# EasyEDA Pro project MyWordEdit.eprj, board PCB1
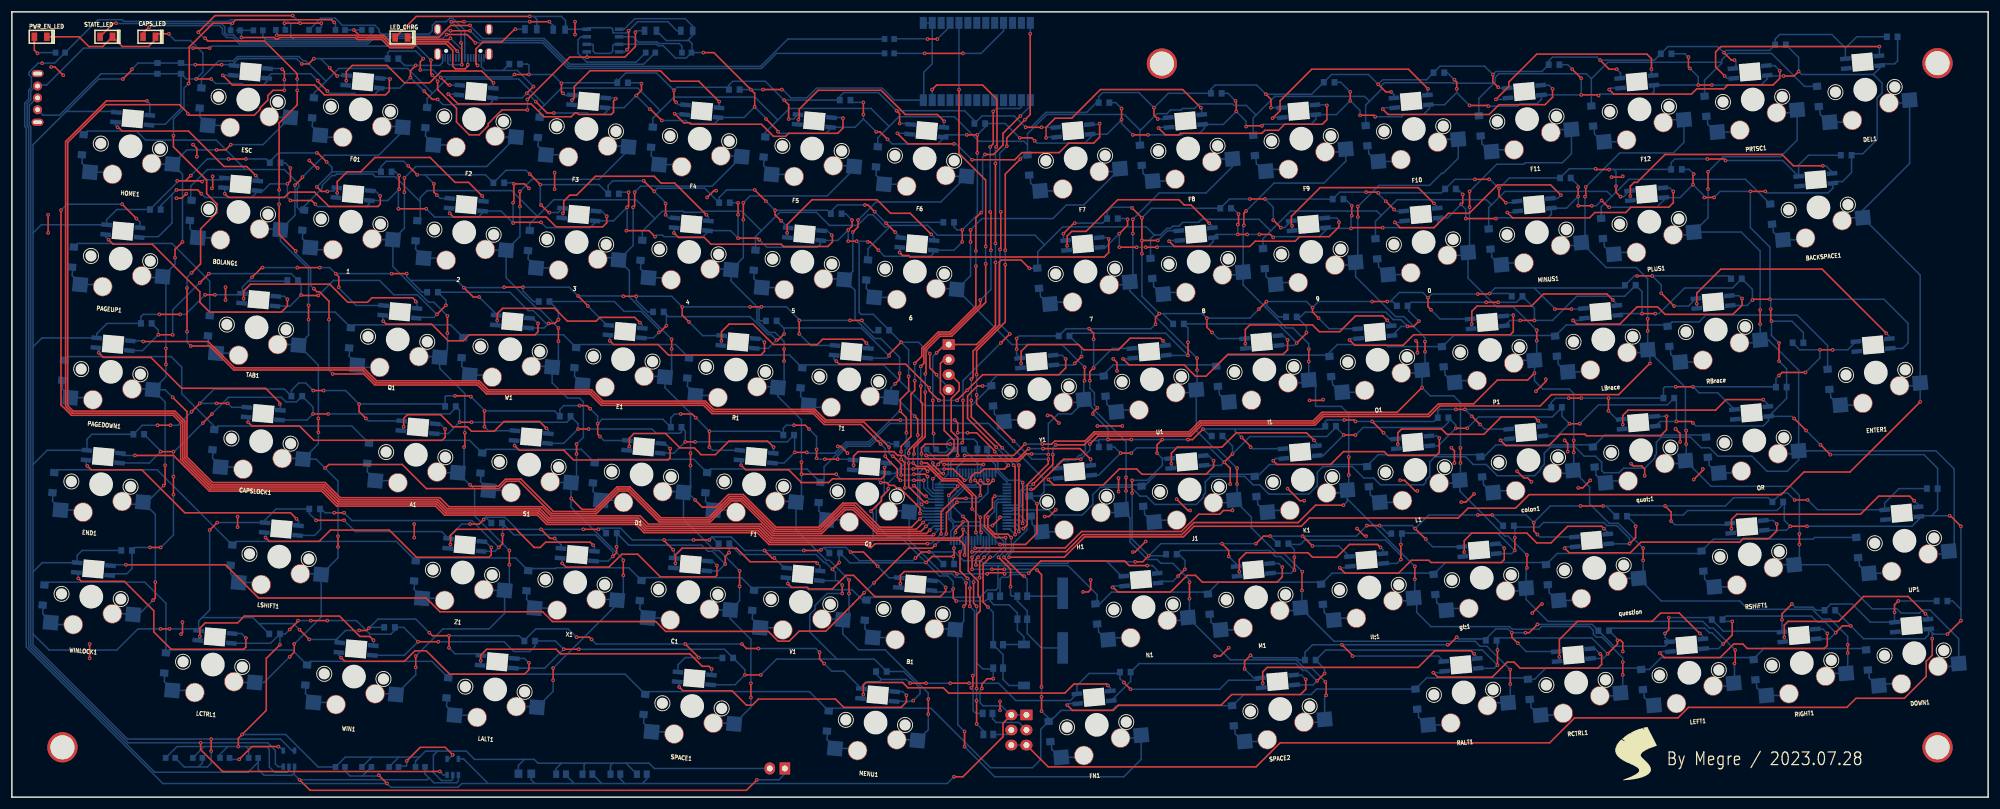
[diagram p2: board, top side]
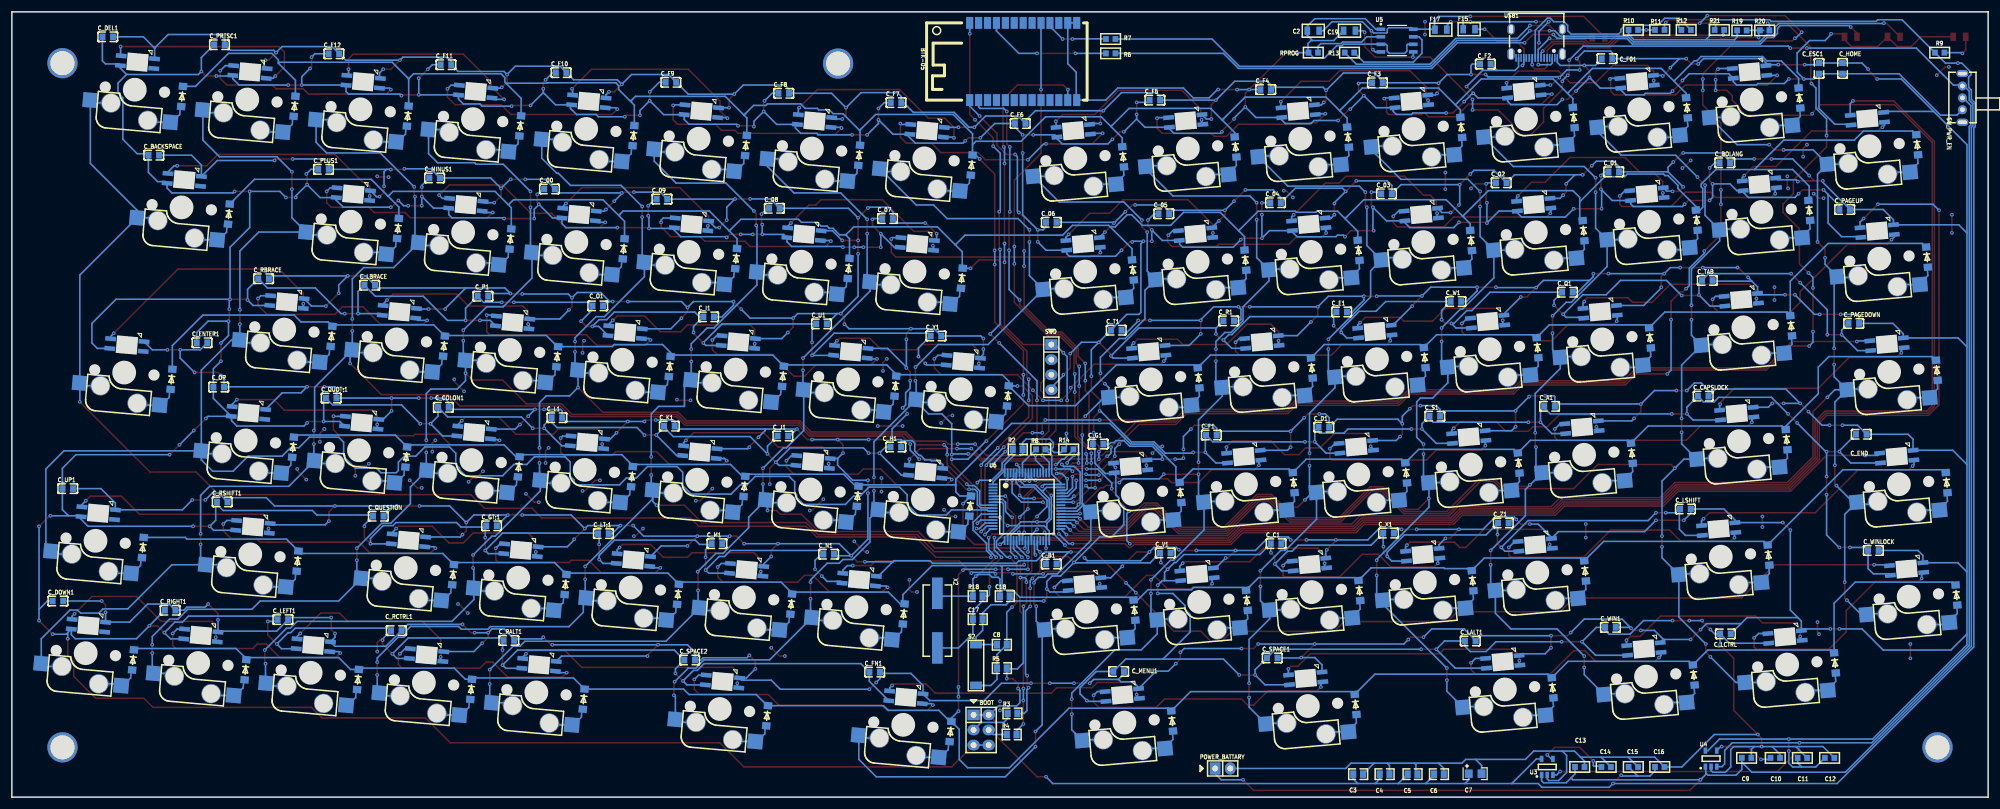
[diagram p3: board, bottom side, seen from below]

Outline 332.49 x 132.21 mm; copper layers: Top Layer, Bottom Layer. Coordinates in mm from the lower left corner of the outline.
Outline path: 0,132.21 332.49,132.21 332.49,0 0,0 0,132.2 0,132.21
Stack: Top Layer 0.035mm / Dielectric1 1.51mm FR4 er 4.5 / Bottom Layer 0.035mm

## Design rules (mm)
template: JLCPCB Capability(Two Layers Board)
spacing copperThickness1oz (default): track to track 0.102, other pairs 0.152 to 0.3
spacing copperThickness2oz: track to track 0.203, other pairs 0.152 to 0.3
track width copperThickness1oz (default): min 0.127, default 0.254, max 2.54
track width copperThickness2oz: min 0.203, default 0.254, max 2.54
differential pair differentialPair (default): width min 0.127, default 0.254, max 2.54; gap min 0.152, default 0.152
via viaSize (default): diameter min 0.5, default 0.61, max 10; hole min 0.3, default 0.305, max 6.3

## Placement (name value [footprint] x y rotation side)
0  -  [KAILH_WS2182B_3528 反贴]  237.49 93.47 5 top
1  -  [KAILH_WS2182B_3528 反贴]  57.02 96.9 355 top
2  -  [KAILH_WS2182B_3528 反贴]  76.07 95.12 355 top
3  -  [KAILH_WS2182B_3528 反贴]  95 93.47 355 top
4  -  [KAILH_WS2182B_3528 反贴]  113.92 91.82 355 top
5  -  [KAILH_WS2182B_3528 反贴]  132.97 90.17 355 top
6  -  [KAILH_WS2182B_3528 反贴]  151.89 88.52 355 top
7  -  [KAILH_WS2182B_3528 反贴]  180.59 88.52 5 top
8  -  [KAILH_WS2182B_3528 反贴]  199.64 90.17 5 top
9  -  [KAILH_WS2182B_3528 反贴]  218.57 91.82 5 top
A1  -  [KAILH_WS2182B_3528 反贴]  67.95 57.66 355 top
B1  -  [KAILH_WS2182B_3528 反贴]  151.64 31.24 355 top
BACKSPACE1  -  [KAILH_WS2182B_3528 反贴]  303.91 99.31 5 top
BOLANG1  -  [KAILH_WS2182B_3528 反贴]  38.1 98.55 355 top
BOOT  HDR2x3  [PIN-2x3-2.54-1.0]  169.42 11.3 270 bottom
BTK-05  BTK-05-blueteeth  [BTK-05-bluteeth]  164.59 124.05 90 bottom
C1  -  [KAILH_WS2182B_3528 反贴]  113.79 34.54 355 top
C2  10uf  [0805]  113.54 129.03 180 bottom
C3  100nF  [RC0603]  106.81 3.86 180 bottom
C4  100nF  [RC0603]  102.36 3.86 180 bottom
C5  100nF  [RC0603]  97.66 3.86 180 bottom
C6  100nF  [RC0603]  93.22 3.86 180 bottom
C7  10uf  [CAP0805]  87.38 3.94 180 bottom
C8  100nF  [RC0603]  165.1 25.65 0 bottom
C9  105  [0603]  40.64 6.6 180 bottom
C10  22nf  [0603]  35.81 6.6 180 bottom
C11  104  [0603]  31.25 6.6 180 bottom
C12  105  [0603]  26.67 6.6 180 bottom
C13  105  [0603]  68.71 5.08 180 bottom
C14  22nf  [0603]  64.26 5.08 180 bottom
C15  104  [0603]  59.69 5.08 180 bottom
C16  105  [0603]  55.25 5.08 180 bottom
C17  20pF  [RC0603]  170.82 29.96 180 bottom
C18  20pF  [RC0603]  166.25 33.83 180 bottom
C19  10uf  [0805]  107.44 129.03 180 bottom
C_00  100nF  [C0603]  242.04 102.39 180 bottom
C_01  100nF  [C0603]  62.99 105.28 180 bottom
C_02  100nF  [C0603]  81.92 103.43 180 bottom
C_03  100nF  [C0603]  101.22 101.57 180 bottom
C_04  100nF  [C0603]  119.89 100.08 180 bottom
C_05  100nF  [C0603]  138.68 98.22 180 bottom
C_06  100nF  [C0603]  157.61 96.77 180 bottom
C_07  100nF  [C0603]  185.17 97.41 180 bottom
C_08  100nF  [C0603]  204.2 99.14 180 bottom
C_09  100nF  [C0603]  223.12 100.68 180 bottom
C_A1  100nF  [C0603]  73.79 65.79 180 bottom
C_B1  100nF  [C0603]  157.61 39.24 180 bottom
C_BACKSPACE  100nF  [C0603]  308.61 108.08 180 bottom
C_BOLANG  100nF  [C0603]  44.3 106.81 180 bottom
C_C1  100nF  [C0603]  119.8 42.67 180 bottom
C_CAPSLOCK  100nF  [C0603]  47.93 67.51 180 bottom
C_COLON1  100nF  [C0603]  259.88 65.63 180 bottom
C_D1  100nF  [C0603]  111.76 62.28 180 bottom
C_DEL1  100nF  [C0603]  316.36 128.02 180 bottom
C_DOWN1  100nF  [C0603]  324.74 33.02 180 bottom
C_E1  100nF  [C0603]  108.76 81.69 180 bottom
C_END  100nF  [C0603]  21.34 61.09 180 bottom
C_ENTER1  100nF  [C0603]  300.5 76.5 180 bottom
C_ESC1  100nF  [C0603]  28.45 122.69 90 bottom
C_F1  100nF  [C0603]  130.68 60.96 180 bottom
C_F01  100nF  [C0603]  64.12 124.33 180 bottom
C_F2  100nF  [C0603]  84.58 123.41 0 bottom
C_F3  100nF  [C0603]  102.74 120.27 180 bottom
C_F4  100nF  [C0603]  121.54 119.13 180 bottom
C_F5  100nF  [C0603]  140.18 117.35 180 bottom
C_F6  100nF  [C0603]  162.84 113.41 180 bottom
C_F7  100nF  [C0603]  183.74 116.92 180 bottom
C_F8  100nF  [C0603]  202.63 118.5 180 bottom
C_F9  100nF  [C0603]  221.62 120.35 180 bottom
C_F10  100nF  [C0603]  240.09 121.98 180 bottom
C_F11  100nF  [C0603]  259.46 123.32 180 bottom
C_F12  100nF  [C0603]  278.31 125.15 180 bottom
C_FN1  100nF  [C0603]  187.33 21.05 180 bottom
C_G1  100nF  [C0603]  149.73 59.44 180 bottom
C_GT;1  100nF  [C0603]  251.79 45.68 180 bottom
C_H1  100nF  [C0603]  183.77 58.95 180 bottom
C_HOME  100nF  [C0603]  24.49 122.69 90 bottom
C_I1  100nF  [C0603]  215.27 80.86 180 bottom
C_J1  100nF  [C0603]  202.77 60.8 180 bottom
C_K1  100nF  [C0603]  221.87 62.45 180 bottom
C_L1  100nF  [C0603]  240.79 63.88 180 bottom
C_LALT1  100nF  [C0603]  87.12 26.29 180 bottom
C_LBRACE  100nF  [C0603]  272.29 86.18 180 bottom
C_LCTRL  100nF  [C0603]  44.2 27.48 180 bottom
C_LEFT1  100nF  [C0603]  286.89 29.89 180 bottom
C_LSHIFT  100nF  [C0603]  50.93 48.51 180 bottom
C_LT;1  100nF  [C0603]  232.97 44.37 180 bottom
C_M1  100nF  [C0603]  213.87 42.67 180 bottom
C_MENU1  100nF  [C0603]  146.28 21.15 180 bottom
C_MINUS1  100nF  [C0603]  261.37 104.24 180 bottom
C_N1  100nF  [C0603]  195.07 40.89 180 bottom
C_O1  100nF  [C0603]  233.92 82.71 180 bottom
C_OR  100nF  [C0603]  297.69 69.04 180 bottom
C_P1  100nF  [C0603]  253.24 84.33 180 bottom
C_PAGEDOWN  100nF  [C0603]  22.61 79.76 180 bottom
C_PAGEUP  100nF  [C0603]  24.13 98.93 180 bottom
C_PLUS1  100nF  [C0603]  280.06 105.69 180 bottom
C_PRTSC1  100nF  [C0603]  297.56 126.68 180 bottom
C_Q1  100nF  [C0603]  70.77 85 180 bottom
C_QUESTION  100nF  [C0603]  270.84 47.29 180 bottom
C_QUOT;1  100nF  [C0603]  278.77 67.18 180 bottom
C_R1  100nF  [C0603]  127.76 80.19 180 bottom
C_RALT1  100nF  [C0603]  248.88 26.38 180 bottom
C_RBRACE  100nF  [C0603]  290.14 87.28 180 bottom
C_RCTRL1  100nF  [C0603]  267.81 28.03 180 bottom
C_RIGHT1  100nF  [C0603]  305.86 31.46 180 bottom
C_RSHIFT1  100nF  [C0603]  297.1 49.71 180 bottom
C_S1  100nF  [C0603]  93.09 64.13 180 bottom
C_SPACE1  100nF  [C0603]  120.44 23.43 180 bottom
C_SPACE2  100nF  [C0603]  218.45 23.08 180 bottom
C_T1  100nF  [C0603]  146.69 78.61 180 bottom
C_TAB  100nF  [C0603]  47.24 86.99 180 bottom
C_U1  100nF  [C0603]  196.27 79.68 180 bottom
C_UP1  100nF  [C0603]  323.09 51.94 180 bottom
C_V1  100nF  [C0603]  138.43 41.1 180 bottom
C_W1  100nF  [C0603]  89.54 83.44 180 bottom
C_WIN1  100nF  [C0603]  63.54 28.58 180 bottom
C_WINLOCK  100nF  [C0603]  19.3 41.53 180 bottom
C_X1  100nF  [C0603]  100.88 44.45 180 bottom
C_Y1  100nF  [C0603]  177.02 77.64 180 bottom
C_Z1  100nF  [C0603]  81.57 46.16 180 bottom
CAPS_LED  LED  [LED-0805]  23.11 128.02 0 top
CAPSLOCK1  -  [KAILH_WS2182B_3528 反贴]  41.91 59.94 355 top
colon1  -  [KAILH_WS2182B_3528 反贴]  255.14 56.77 5 top
D1  -  [KAILH_WS2182B_3528 反贴]  105.92 54.36 355 top
DEL1  -  [KAILH_WS2182B_3528 反贴]  311.79 119.13 5 top
DOWN1  -  [KAILH_WS2182B_3528 反贴]  320.04 24.26 5 top
E1  -  [KAILH_WS2182B_3528 反贴]  102.8 73.76 355 top
END1  -  [KAILH_WS2182B_3528 反贴]  14.99 52.7 355 top
ENTER1  -  [KAILH_WS2182B_3528 反贴]  313.56 71.5 5 top
ESC  -  [KAILH_WS2182B_3528 反贴]  39.75 117.47 355 top
F1  -  [KAILH_WS2182B_3528 反贴]  124.84 52.7 355 top
F01  -  [KAILH_WS2182B_3528 反贴]  58.67 115.82 355 top
F2  -  [KAILH_WS2182B_3528 反贴]  77.72 114.17 355 top
F3  -  [KAILH_WS2182B_3528 反贴]  96.65 112.52 355 top
F4  -  [KAILH_WS2182B_3528 反贴]  115.7 110.87 355 top
F5  -  [KAILH_WS2182B_3528 反贴]  134.62 109.22 355 top
F6  -  [KAILH_WS2182B_3528 反贴]  153.54 107.57 355 top
F7  -  [KAILH_WS2182B_3528 反贴]  178.94 107.57 5 top
F8  -  [KAILH_WS2182B_3528 反贴]  197.87 109.22 5 top
F9  -  [KAILH_WS2182B_3528 反贴]  216.92 110.87 5 top
F10  -  [KAILH_WS2182B_3528 反贴]  235.84 112.52 5 top
F11  -  [KAILH_WS2182B_3528 反贴]  254.89 114.17 5 top
F12  -  [KAILH_WS2182B_3528 反贴]  273.81 115.82 5 top
F15  500mA  [0805]  87.32 129.29 180 bottom
F17  500mA  [0805]  92.08 129.21 180 bottom
FN1  -  [KAILH_WS2182B_3528 反贴]  182.5 12.19 5 top
G1  -  [KAILH_WS2182B_3528 反贴]  143.89 51.05 355 top
gt;1  -  [KAILH_WS2182B_3528 反贴]  247.27 36.96 5 top
H1  -  [KAILH_WS2182B_3528 反贴]  179.2 50.16 5 top
HOME1  -  [KAILH_WS2182B_3528 反贴]  19.94 109.6 355 top
I1  -  [KAILH_WS2182B_3528 反贴]  210.69 72.01 5 top
J1  -  [KAILH_WS2182B_3528 反贴]  198.12 51.82 5 top
K1  -  [KAILH_WS2182B_3528 反贴]  217.17 53.47 5 top
L1  -  [KAILH_WS2182B_3528 反贴]  236.09 55.12 5 top
LALT1  -  [KAILH_WS2182B_3528 反贴]  81.28 18.16 355 top
LBrace  -  [KAILH_WS2182B_3528 反贴]  267.72 77.09 5 top
LCTRL1  -  [KAILH_WS2182B_3528 反贴]  33.78 22.35 355 top
LED_CHRG  LED  [LED-0805]  65.53 127.89 0 top
LEFT1  -  [KAILH_WS2182B_3528 反贴]  282.19 20.95 5 top
LSHIFT1  -  [KAILH_WS2182B_3528 反贴]  44.96 40.51 355 top
lt;1  -  [KAILH_WS2182B_3528 反贴]  228.35 35.31 5 top
M1  -  [KAILH_WS2182B_3528 反贴]  209.3 33.66 5 top
MENU1  -  [KAILH_WS2182B_3528 反贴]  145.29 12.57 355 top
MINUS1  -  [KAILH_WS2182B_3528 反贴]  256.54 95.12 5 top
N1  -  [KAILH_WS2182B_3528 反贴]  190.37 32 5 top
NOREF  -  [Pad_e82422]  323.98 123.57 0 top
NOREF#2  -  [Pad_e82437]  193.48 123.51 0 top
NOREF#3  -  [Pad_e82416]  323.98 8.38 0 top
NOREF#4  -  [Pad_e82421]  8.51 8.38 0 top
O1  -  [KAILH_WS2182B_3528 反贴]  229.74 73.66 5 top
OR  -  [KAILH_WS2182B_3528 反贴]  293.12 60.07 5 top
P1  -  [KAILH_WS2182B_3528 反贴]  248.67 75.31 5 top
PAGEDOWN1  -  [KAILH_WS2182B_3528 反贴]  16.64 71.63 355 top
PAGEUP1  -  [KAILH_WS2182B_3528 反贴]  18.29 90.68 355 top
PLUS1  -  [KAILH_WS2182B_3528 反贴]  275.46 96.9 5 top
POWER_BATTARY  HDR1x2  [PIN-2-2.54-1.0]  128.78 4.83 180 bottom
PRTSC1  -  [KAILH_WS2182B_3528 反贴]  292.86 117.47 5 top
PWR_EN_LED  LED  [LED-0805]  4.83 128.02 0 top
Q1  -  [KAILH_WS2182B_3528 反贴]  64.9 77.09 355 top
question  -  [KAILH_WS2182B_3528 反贴]  266.19 38.61 5 top
quot;1  -  [KAILH_WS2182B_3528 反贴]  274.07 58.42 5 top
R1  -  [KAILH_WS2182B_3528 反贴]  121.79 72.01 355 top
R2  0R  [RC0603]  164.08 58.55 180 bottom
R3  10K  [RC0603]  164.97 14.1 180 bottom
R4  10K  [RC0603]  163.45 10.54 0 bottom
R5  10K  [RC0603]  166.75 21.72 180 bottom
R6  1k  [0603]  147.63 125.22 180 bottom
R7  1k  [0603]  147.63 127.63 180 bottom
R8  10K  [0603]  159.39 58.55 0 bottom
R9  1k  [0603]  8.15 125.35 0 bottom
R10  1.5K  [0603]  59.69 129.17 180 bottom
R11  22R  [0603]  55.25 129.17 0 bottom
R12  22R  [0603]  50.8 129.17 180 bottom
R13  1k  [0603]  107.44 125.35 0 bottom
R14  10K  [0603]  154.69 58.55 180 bottom
R18  1M  [RC0603]  170.82 33.84 180 bottom
R19  1.5K  [0603]  41.43 129.09 180 bottom
R20  22R  [0603]  37.59 129.09 0 bottom
R21  22R  [0603]  45.21 129.17 180 bottom
RALT1  -  [KAILH_WS2182B_3528 反贴]  244.22 17.65 5 top
RBrace  -  [KAILH_WS2182B_3528 反贴]  286.64 78.74 5 top
RCTRL1  -  [KAILH_WS2182B_3528 反贴]  263.14 19.3 5 top
RIGHT1  -  [KAILH_WS2182B_3528 反贴]  301.12 22.61 5 top
RPROG  2k  [0603]  113.54 125.35 180 bottom
RSHIFT1  -  [KAILH_WS2182B_3528 反贴]  292.35 40.89 5 top
S1  -  [KAILH_WS2182B_3528 反贴]  87 56.01 355 top
S2  RESET  [SMT-KEY]  170.28 18.8 180 bottom
SPACE1  -  [KAILH_WS2182B_3528 反贴]  114.43 15.37 355 top
SPACE2  -  [KAILH_WS2182B_3528 反贴]  213.36 14.86 5 top
STATE_LED  LED  [LED-0805]  15.88 128.02 0 top
SW_PWR_EN  SWITCH-SPST  [SW-TH_SK-12D02-G040]  4.32 117.73 90 bottom
SWD  HDR1x4  [PIN-4-2.54-1.0]  157.61 72.39 270 bottom
T1  -  [KAILH_WS2182B_3528 反贴]  140.84 70.36 355 top
TAB1  -  [KAILH_WS2182B_3528 反贴]  41.15 79.12 355 top
U1  -  [KAILH_WS2182B_3528 反贴]  191.77 70.36 5 top
U3  RT9193-33GB  [SOT-23-5]  74.17 5.08 180 bottom
U4  RT9193-46GB  [SOT-23-5]  46.61 6.48 180 bottom
U5  TP4056  [ESOP8]  99.44 127.38 180 bottom
U6  STM32F103RCT6  [QFP-64-0.5]  161.71 48.89 180 bottom
UP1  -  [KAILH_WS2182B_3528 反贴]  318.39 43.18 5 top
USB1  -  [USB_TYPE-C-16P]  75.82 126.87 0 bottom
V1  -  [KAILH_WS2182B_3528 反贴]  132.72 32.89 355 top
W1  -  [KAILH_WS2182B_3528 反贴]  83.82 75.44 355 top
WIN1  -  [KAILH_WS2182B_3528 反贴]  57.53 20.32 355 top
WINLOCK1  -  [KAILH_WS2182B_3528 反贴]  13.34 33.78 355 top
X1  -  [KAILH_WS2182B_3528 反贴]  94.74 36.19 355 top
X2  8MHz  [HC49-SMD]  176.78 29.72 270 bottom
Y1  -  [KAILH_WS2182B_3528 反贴]  172.85 68.71 5 top
Z1  -  [KAILH_WS2182B_3528 反贴]  75.82 37.85 355 top

## Footprints (pads in the part's own frame, mm; a bottom-side part is the same pattern mirrored in y, then rotated)
0603
  rect 0.95x1 smd: 1(-0.8,0) 2(0.8,0)
0805
  rect 0.95x1.4 smd: 1(-1,0) 2(1,0)
BTK-05-bluteeth
  rect 2x1.2 smd: 1(-6.7,6.75) 2(-6.7,5.25) 3(-6.7,3.75) 4(-6.7,2.25) 5(-6.7,0.75) 6(-6.7,-0.75) 7(-6.7,-2.25) 8(-6.7,-3.75) 9(-6.7,-5.25) 10(-6.7,-6.75) 11(-6.7,-8.25) 12(-6.7,-9.75) 13(-6.7,-11.25) 22(6.3,-11.25) 23(6.3,-9.75) 24(6.3,-8.25) 25(6.3,-6.75) 26(6.3,-5.25) 27(6.3,-3.75) 28(6.3,-2.25) 29(6.3,-0.75) 30(6.3,0.75) 31(6.3,2.25) 32(6.3,3.75) 33(6.3,5.25) 34(6.3,6.75)
C0603
  rect 1x1.1 smd: 1(0.9,0) 2(-0.9,0)
CAP0805
  rect 1.321x1.423 smd: 1(0,0) 2(2.159,0)
ESOP8
  rect 1.45x0.6 smd: 1(-2.725,1.905) 2(-2.725,0.635) 3(-2.725,-0.635) 4(-2.725,-1.905) 5(2.725,-1.905) 6(2.725,-0.635) 7(2.725,0.635) 8(2.725,1.905)
HC49-SMD
  rect 5.3x1.8 smd: 1(-4.6,0) 2(4.6,0)
KAILH_WS2182B_3528 反贴
  round 3.251 hole 3: COL(3.81,-2.591) R0(-2.591,-4.979)
  rect 2.55x2.5 smd far side: COL(7.315,-2.413) R0(-6.401,-4.953)
  rect 1.8x0.75 smd far side: DIN(2.794,5.461) DOUT(-2.845,3.81) GND(2.794,3.81) VCC(-2.845,5.461)
  rect 1.4x1.2 smd far side: R0(-8.001,-2.159) ROW(-8.001,1.241)
LED-0805
  rect 0.95x1.4 smd: 1(-1.05,0) 2(1.05,0)
Pad_e82416
  round 5.08 hole 4.064: 65(0,0)
Pad_e82421
  round 5.08 hole 4.064: 65(0,0)
Pad_e82422
  round 5.08 hole 4.064: 65(0,0)
Pad_e82437
  round 5.08 hole 4.064: 65(0,0)
PIN-2-2.54-1.0
  rect 1.778x2.032 hole 1: 1(-1.27,0)
  oval 1.778x2.032 hole 1: 2(1.27,0)
PIN-2x3-2.54-1.0
  rect 1.778x2.032 hole 1: 1(-2.54,-1.27)
  oval 1.778x2.032 hole 1: 2(-2.54,1.27) 3(0,-1.27) 4(0,1.27) 5(2.54,-1.27) 6(2.54,1.27)
PIN-4-2.54-1.0
  rect 1.778x2.032 hole 1: 1(-3.81,0)
  oval 1.778x2.032 hole 1: 2(-1.27,0) 3(1.27,0) 4(3.81,0)
QFP-64-0.5
  rect 1.5x0.3 smd: 1(-5.7,3.75) 2(-5.7,3.25) 3(-5.7,2.75) 4(-5.7,2.25) 5(-5.7,1.75) 6(-5.7,1.25) 7(-5.7,0.75) 8(-5.7,0.25) 9(-5.7,-0.25) 10(-5.7,-0.75) 11(-5.7,-1.25) 12(-5.7,-1.75) 13(-5.7,-2.25) 14(-5.7,-2.75) 15(-5.7,-3.25) 16(-5.7,-3.75) 33(5.7,-3.75) 34(5.7,-3.25) 35(5.7,-2.75) 36(5.7,-2.25) 37(5.7,-1.75) 38(5.7,-1.25) 39(5.7,-0.75) 40(5.7,-0.25) 41(5.7,0.25) 42(5.7,0.75) 43(5.7,1.25) 44(5.7,1.75) 45(5.7,2.25) 46(5.7,2.75) 47(5.7,3.25) 48(5.7,3.75)
  rect 0.3x1.5 smd: 17(-3.75,-5.7) 18(-3.25,-5.7) 19(-2.75,-5.7) 20(-2.25,-5.7) 21(-1.75,-5.7) 22(-1.25,-5.7) 23(-0.75,-5.7) 24(-0.25,-5.7) 25(0.25,-5.7) 26(0.75,-5.7) 27(1.25,-5.7) 28(1.75,-5.7) 29(2.25,-5.7) 30(2.75,-5.7) 31(3.25,-5.7) 32(3.75,-5.7) 49(3.75,5.7) 50(3.25,5.7) 51(2.75,5.7) 52(2.25,5.7) 53(1.75,5.7) 54(1.25,5.7) 55(0.75,5.7) 56(0.25,5.7) 57(-0.25,5.7) 58(-0.75,5.7) 59(-1.25,5.7) 60(-1.75,5.7) 61(-2.25,5.7) 62(-2.75,5.7) 63(-3.25,5.7) 64(-3.75,5.7)
RC0603
  rect 1.016x1.27 smd: 1(0,0) 2(1.651,0)
SMT-KEY
  rect 2x1.3 smd: 1(0,0) 2(0,6.9)
SOT-23-5
  rect 0.6x1.05 smd: 1(-0.95,-1.35) 2(0,-1.35) 3(0.95,-1.35) 4(0.95,1.35) 5(-0.95,1.35)
SW-TH_SK-12D02-G040
  round 1.5 hole 0.8: 1(-2,0) 2(0,0) 3(2,0)
  oval 1.2x2 hole 0.6x1.5: 4(-4.1,0) 5(4.1,0)
USB_TYPE-C-16P
  oval 1.2x2 hole 0.7x1.7: 1(-4.193,1.765) 2(4.447,1.765)
  oval 1.2x1.8 hole 0.7x1.4: 3(-4.193,-2.415) 4(4.447,-2.415)
  rect 0.25x1.3 smd: A1(-3.33,2.415) A4(-2.493,2.415) A9(2.747,2.415) A12(3.606,2.415) B1(3.177,2.415) B4(2.307,2.415) B9(-2.053,2.415) B12(-2.923,2.415)
  rect 0.3x1.3 smd: A5(-1.123,2.415) A6(-0.123,2.415) A7(0.377,2.415) A8(1.377,2.415) B5(1.877,2.415) B6(0.877,2.415) B7(-0.623,2.415) B8(-1.623,2.415)

## Nets
As in the schematic, except:
3V7: C9.1 C13.1 C19.2 POWER_BATTARY.1 SW_PWR_EN.3 U3.1 U4.1 U5.5

Pads without a net: 0 R0; 1 R0; 2 R0; 3 R0; 4 R0; 5 R0; 6 R0; 7 R0; 8 R0; 9 R0; A1 R0; B1 R0; BACKSPACE1 DOUT R0; BOLANG1 R0; BTK-05 3 4 5 6 7 8 9 10 11 24 27 28 29 30 32 33; C1 R0; CAPSLOCK1 R0; colon1 R0; D1 R0; DEL1 DOUT R0; DOWN1 DOUT R0; E1 R0; END1 R0; ENTER1 DOUT R0; ESC R0; F1 R0; F01 R0; F2 R0; F3 R0; F4 R0; F5 R0; F6 R0; F7 R0; F8 R0; F9 R0; F10 R0; F11 R0; F12 R0; FN1 R0; G1 R0; gt;1 R0; H1 R0; HOME1 R0; I1 R0; J1 R0; K1 R0; L1 R0; LALT1 R0; LBrace R0; LCTRL1 R0; LEFT1 R0; LSHIFT1 R0; lt;1 R0; M1 R0; MENU1 R0; MINUS1 R0; N1 R0; NOREF 65; NOREF#2 65; NOREF#3 65; NOREF#4 65; O1 R0; OR DOUT R0; P1 R0; PAGEDOWN1 R0; PAGEUP1 R0; PLUS1 R0; PRTSC1 R0; Q1 R0; question R0; quot;1 R0; R1 R0; RALT1 R0; RBrace R0; RCTRL1 R0; RIGHT1 R0; RSHIFT1 R0; S1 R0; SPACE1 R0; SPACE2 R0; SW_PWR_EN 4 5; T1 R0; TAB1 R0; U1 R0; U6 2 3 4 29 30 41 50 52 53 54 62; UP1 DOUT R0; USB1 1 2 3 4 A5 A8 A9 A12 B5 B8 B9 B12; V1 R0; W1 R0; WIN1 R0; WINLOCK1 R0; X1 R0; Y1 R0; Z1 R0

## Via types
v1: diameter 0.61, hole 0.305, Top Layer to Bottom Layer, 1214 vias

## Routing (per net, layer and track width the routed paths; a pad name or vN(x,y) marks a point on that pad's centre or on a via; arc(x,y) is an arc through that point)
3V3: length 553.1
  Top Layer w0.254: v1(165.1,19.94) 164.08,19.94 163.2,19.05 v1(163.2,18.29) ; v1(157.61,50.8) v1(159.13,52.32) ; v1(161.8,36.19) 161.8,32.64 v1(162.31,32.13) ; v1(154.81,119.13) 155.58,119.89 163.32,119.89 165.74,117.47 165.74,109.6 v1(165.61,109.47) ; v1(163.58,40.39) 162.81,39.62 v1(162.81,36.96) ; v1(158.5,3.43) 160.02,3.43 166.75,10.16 166.75,12.45 BOOT.2 ; v1(165.48,90.04) 165.48,79.37 162.31,76.2 SWD.1 156.97,76.2 v1(155.58,74.8) ; v1(63.12,2.29) v1(61.72,3.68) ; v1(165.48,106.68) v1(165.48,93.22) ; v1(154.94,66.8) 154.94,61.34 v1(155.07,61.21)
  Bottom Layer w0.254: 47.37,127.63 47.24,127.51 42.67,127.51 42.23,127.95 R19.1 ; 47.37,127.63 46.9,128.1 46.9,130.14 46.15,130.89 36.78,130.89 36.5,130.61 18.84,130.61 18.56,130.89 14.48,130.89 R9.2 7.17,123.57 v1(5.08,123.57) 4.42,123.57 2.85,122.01 2.85,121.65 3.29,121.21 3.29,119.49 2.82,119.02 2.82,117.5 2.16,116.83 2.16,112.91 2.41,112.65 2.41,25.28 25.41,2.29 v1(63.12,2.29) 63.75,1.65 75.06,1.65 75.69,2.29 80.14,2.29 ; 47.37,127.63 47.5,127.51 59.56,127.51 60.49,128.44 R10.1 ; 88.01,2.29 87.38,2.91 C7.1 ; 88.01,2.29 80.14,2.29 ; 88.01,2.29 94.62,2.29 ; 80.14,2.29 75.99,6.43 U3.5 ; v1(165.1,19.94) R5.2 164.97,21.59 163.32,21.59 162.31,22.61 v1(162.31,32.13) ; 106.05,2.29 103.12,2.29 ; 106.05,2.29 106.81,3.05 C3.1 ; 106.05,2.29 157.35,2.29 v1(158.5,3.43) ; 103.12,2.29 102.24,3.17 102.36,3.3 C4.1 ; 103.12,2.29 99.24,2.29 ; BTK-05.12 154.84,119.1 v1(154.81,119.13) ; 99.24,2.29 C5.1 ; 99.24,2.29 94.62,2.29 ; 158.37,45.21 158.83,45.67 162.86,45.67 164.46,44.07 U6.19 164.46,41.27 v1(163.58,40.39) ; 158.37,45.21 158.37,46.11 157.61,46.87 v1(157.61,50.8) ; 158.37,45.21 157.96,44.8 U6.32 ; 165.48,54.99 165.48,55.95 163.9,57.53 162.69,57.53 162.43,57.78 R2.2 162.43,59.69 161.85,60.27 157.85,60.27 157.28,59.71 157.28,58.91 157.64,58.55 ; 165.48,54.99 167.41,53.06 U6.1 ; 165.48,54.99 165.48,54.61 U6.64 ; v1(162.81,36.96) 162.05,36.96 161.8,36.7 v1(161.8,36.19) ; 94.62,2.29 93.22,3.68 C6.1 ; v1(61.72,3.68) 61.6,3.56 58.97,3.56 ; SWD.1 156.97,76.2 v1(155.58,74.8) 154.94,74.17 v1(154.94,66.8) ; 157.64,58.55 157.12,58.02 155.97,58.02 155.49,58.51 R14.1 155.07,58.97 v1(155.07,61.21) ; 157.64,58.55 R8.1 157.53,57.49 157.53,54.41 156.01,52.89 U6.48 158.81,52.64 v1(159.13,52.32) ; 58.97,3.56 C15.1 ; 58.97,3.56 56.9,3.56 56.05,4.41 C16.1 ; v1(163.2,18.29) 162.89,17.98 162.89,15.89 163.41,15.37 166.48,15.37 167.75,14.1 168.15,14.1 BOOT.2 BOOT.1 ; v1(165.48,90.04) v1(165.48,93.22) ; v1(165.61,109.47) 165.48,109.35 v1(165.48,106.68)
3V7: length 395.1
  Top Layer w0.254: v1(48.39,2.92) 50.17,1.14 123.57,1.14 v1(125.35,2.92) ; v1(70.74,121.54) 70.49,121.79 v1(70.49,124.08) ; v1(86.74,115.7) 82.45,115.7 80.14,113.39 80.14,113.03 78.61,111.51 76.95,111.51 74.8,113.66 74.8,115.95 71.63,119.13 v1(71.63,120.52) ; v1(33.27,126.11) v1(30.48,126.11) ; v1(86.74,117.47) 93.85,124.59 v1(96.77,124.59) 103.12,124.59 104.9,126.36 v1(104.9,128.78)
  Bottom Layer w0.254: 70.17,3.24 69.85,2.92 v1(48.39,2.92) 47.5,3.81 47.5,4.06 ; 70.17,3.24 70.99,2.41 74.8,2.41 75.12,2.73 U3.1 ; 70.17,3.24 69.51,3.9 C13.1 ; v1(104.9,128.78) 105.16,129.03 C19.2 ; 47.5,4.06 47.12,3.68 42.42,3.68 41.44,4.66 41.44,5.88 ; 47.5,4.06 47.5,5.07 U4.1 ; SW_PWR_EN.3 4.03,119.73 3.18,118.87 3.18,117.35 2.57,116.74 2.57,113 2.82,112.75 2.82,25.38 24.01,4.19 39.75,4.19 41.44,5.88 ; 4.19,119.89 5.84,119.89 12.07,126.11 v1(30.48,126.11) ; v1(71.63,120.52) 71.63,120.65 v1(70.74,121.54) ; 41.44,5.88 C9.1 ; v1(86.74,115.7) v1(86.74,117.47) ; v1(33.27,126.11) 33.6,126.44 68.12,126.44 v1(70.49,124.08) ; U5.5 96.72,124.64 v1(96.77,124.59) ; POWER_BATTARY.1 130.05,3.94 129.03,2.92 v1(125.35,2.92)
5V: length 60.7
  Top Layer w0.254: v1(103.76,129.03) 103.76,126.11 v1(103.51,125.86) ; v1(87.12,131.44) 68.04,131.44 LED_CHRG.1
  Bottom Layer w0.254: C2.2 111.89,129.03 110.36,130.56 105.28,130.56 v1(103.76,129.03) 103.38,128.65 101.22,128.65 101.09,128.78 101.09,129.29 100.84,129.54 96.97,129.54 96.72,129.29 93.15,129.29 ; v1(103.51,125.86) 103.12,125.48 U5.4 ; F15.1 88.32,130.94 87.81,131.44 ; 93.15,129.29 F17.1 ; 93.15,129.29 93.15,130.75 92.46,131.44 87.81,131.44 ; v1(87.12,131.44) 87.81,131.44
GND: length 3256.5
  Top Layer w0.254: v1(6.1,98.04) v1(6.1,95) ; v1(54.23,47.88) v1(55.88,47.88) ; v1(197.87,76.58) v1(197.87,74.37) ; v1(145.8,92.07) 144.4,93.47 v1(144.02,93.47) ; v1(286,119.89) v1(283.72,119.89) ; v1(27.69,102.23) 31.24,102.23 v1(31.88,101.6) ; v1(125.98,20.57) v1(123.32,20.57) ; v1(279.91,61.98) 280.67,61.21 v1(280.67,59.82) ; PWR_EN_LED.2 11.3,128.02 12.95,126.36 15.27,126.36 STATE_LED.2 18.58,126.36 22.99,126.36 24.16,127.54 CAPS_LED.2 24.67,128.52 v1(26.42,128.52) ; v1(273.18,45.59) 273.18,43.69 v1(272.16,42.67) ; v1(169.55,111) 171.58,111 v1(172.09,110.49) ; v1(118.49,102.11) 118.11,102.11 v1(116.97,100.96) ; v1(158.5,41.91) 158.5,40.8 158.37,40.67 v1(158.37,40.51) 154.81,40.51 v1(153.8,39.5) ; v1(191.14,111.51) v1(188.6,111.51) ; v1(113.28,59.82) v1(114.94,59.82) ; v1(158.88,33.02) 158.37,33.53 v1(158.37,35.05) ; v1(220.6,66.93) 220.47,66.8 v1(218.31,66.8) ; v1(87,102.49) 86.23,103.25 v1(84.46,103.25) 84.46,100.2 v1(84.33,100.08) ; v1(233.68,40) v1(233.68,42.54) ; v1(206.38,98.17) 206.38,96.52 v1(206.25,96.39) ; v1(188.34,57.91) v1(186.54,57.91) ; v1(263.53,52.07) 264.29,52.07 v1(265.56,53.34) ; v1(192.66,92.58) v1(190.77,92.58) ; v1(230.63,95.88) 225.43,95.88 v1(225.3,95.76) ; v1(209.88,94.74) 211.71,94.74 v1(212.22,94.23) ; v1(205.36,57.78) v1(203.96,56.39) 204.98,55.37 v1(204.98,52.7) ; v1(282.83,62.99) 282.58,63.25 v1(280.04,63.25) ; v1(158.75,44.58) 158.75,44.94 160.02,46.21 v1(160.02,46.35) ; v1(207.65,112.9) 207.77,113.03 v1(210.31,113.03) ; v1(91.95,80.39) 91.31,79.76 v1(90.3,79.76) ; v1(309.37,28.83) 307.98,28.83 v1(306.83,27.69) ; v1(155.58,71.12) 154.43,72.26 v1(154.43,74.68) ; v1(50.04,107.19) 51.31,105.92 v1(51.44,105.92) ; v1(180.21,34.54) 181.1,34.54 181.48,34.92 v1(181.48,36.58) ; v1(204.72,25.15) 203.33,23.75 v1(202.44,23.75) ; v1(29.34,101.6) 28.58,100.84 v1(27.69,100.84) ; v1(282.96,53.47) 284.48,54.99 v1(284.48,55.24) ; v1(91.31,105.16) v1(91.31,102.36) ; v1(292.84,83.69) 292.96,83.82 v1(295.78,83.82) ; v1(196.22,37.21) v1(197.36,38.35) ; v1(142.11,93.6) v1(140.7,93.6) ; v1(255.78,30.99) 257.3,32.51 v1(257.43,32.51) ; v1(276.48,81.41) v1(274.25,81.41) ; v1(205.99,115.44) 205.99,117.09 v1(205.87,117.22) ; v1(65.02,99.06) v1(69.72,99.06) ; v1(150.88,70.87) 150.88,68.34 149.48,66.94 v1(149.48,65.02) 149.48,64.9 150.5,63.88 v1(150.5,61.34) ; v1(51.56,84.45) 48.74,84.45 v1(48.65,84.54) ; v1(71.63,117.47) 70.74,117.47 v1(69.34,118.87) ; v1(187.71,97.28) 187.71,96.27 v1(186.31,94.87) ; v1(185.29,73.79) 185.93,73.15 v1(185.93,71.75) ; v1(186.31,92.58) v1(189.23,92.58) ; v1(243.84,99.82) 244.09,100.08 v1(244.09,101.47) ; v1(81.92,42.04) 82.55,42.67 v1(82.55,44.2) ; v1(122.17,94.11) 125.48,94.11 v1(125.73,93.85) ; v1(71.5,81.28) v1(73.03,82.8) ; v1(246,51.05) 244.6,49.66 v1(243.84,49.66) ; v1(233.55,53.34) 234.32,53.34 236.09,51.56 v1(236.47,51.56) ; v1(65.15,104.65) v1(65.15,102.36) ; v1(195.96,50.16) 197.87,48.26 v1(198.25,48.26) ; v1(25.02,42.04) v1(23.24,42.04) ; v1(129.92,77.98) 128.91,76.96 v1(128.65,76.96) ; v1(186.69,114.05) v1(186.69,115.95) ; v1(327.91,45.59) 326.14,47.37 v1(326.01,47.37) ; v1(35.94,83.69) v1(35.94,85.85) ; v1(305.94,57.66) v1(304.29,59.31) ; v1(164.97,45.72) 166.24,46.99 v1(166.24,47.12) ; v1(226.06,60.96) v1(224.07,60.96) ; v1(25.02,58.17) v1(27.18,58.17) ; v1(236.22,76.83) 236.47,76.58 v1(236.47,74.8) ; v1(264.03,118.24) 266.83,118.24 v1(266.95,118.11) ; v1(297.31,73.41) v1(297.31,76.45) ; v1(323.09,26.67) 323.09,23.88 322.07,22.86 322.07,20.32 318.39,16.64 310.26,16.64 308.74,15.11 282.08,15.11 280.31,13.33 262.91,13.33 258.72,9.14 213.38,9.14 209.34,5.1 174.35,5.1 BOOT.5 ; v1(244.86,62.1) v1(242.92,62.1) ; v1(162.43,108.46) v1(162.43,111.51) v1(160.66,111.51) ; v1(269.11,104.39) 270.89,104.39 v1(271.02,104.52) ; v1(103.51,99.31) 103.76,99.57 v1(103.76,101.85) ; v1(140.59,57.91) 139.45,59.05 v1(138.94,59.05) ; v1(140.72,95.5) 141.35,96.14 v1(141.35,97.15) ; v1(67.06,121.16) 67.06,122.3 v1(67.95,123.19) ; v1(30.48,109.85) 31.12,109.22 v1(31.12,107.82) ; v1(190.75,43.05) 188.98,41.27 v1(188.6,41.27) ; v1(120.02,39.24) 120.02,40.51 v1(120.65,41.15) ; v1(296.04,80.14) 295.91,80.26 v1(295.91,82.17) ; v1(53.09,118.87) 51.44,120.52 v1(51.44,120.65) ; v1(128.91,112.01) 128.91,112.14 v1(126.87,114.17) ; v1(173.74,47.24) 174.5,47.24 v1(175.64,48.39) ; v1(166.24,16.13) v1(166.24,14.6) ; v1(214.63,51.94) 216.66,49.91 v1(217.42,49.91) ; v1(267.46,100.46) 268.61,99.31 v1(268.73,99.31) ; v1(53.09,29.72) v1(50.29,29.72) ; v1(258.06,70.36) 258.06,69.98 v1(256.41,68.33) ; v1(253.75,80.26) v1(256.16,80.26) ; v1(245.24,116.46) 248.29,116.46 v1(248.41,116.33) ; v1(48.13,29.72) 48.13,29.62 v1(46.74,28.22) ; v1(27.18,50.93) v1(27.18,53.97) ; v1(46.86,100.46) 50.42,100.46 v1(51.05,99.82) ; v1(139.7,34.29) v1(139.7,35.69) ; v1(89.03,96.77) 84.46,96.77 v1(84.33,96.65) ; v1(110.11,79.37) 108.97,78.23 v1(108.84,78.23) ; v1(159.89,95.5) v1(159.89,93.48) ; v1(298.07,121.41) 299.85,121.41 v1(300.61,122.17) ; v1(37.97,47.24) v1(37.97,45.47) ; v1(107.32,115.82) 107.44,115.82 v1(109.35,113.92) ; v1(92.84,24.89) v1(95.38,24.89) ; v1(145.42,112.01) 146.05,112.01 v1(147.32,110.74) ; v1(244.6,97.41) v1(249.68,97.41) ; v1(252.86,41.53) v1(252.86,43.69) ; v1(147.57,74.29) 147.57,74.55 v1(149.61,76.58) ; v1(268.48,24.13) 270.13,25.78 v1(270.13,26.42) 270.64,26.42 271.02,26.03 v1(271.02,24.51) ; v1(262.51,122.55) v1(264.03,121.03) ; v1(162.94,53.34) 163.58,52.7 164.47,52.7 v1(165.1,53.34) ; v1(282.83,103.12) 282.83,104.77 v1(282.96,104.9) ; v1(248.03,83.31) v1(250.06,83.31) ; v1(38.1,8.51) 38.1,9.91 v1(38.74,10.54) 42.8,14.6 42.8,23.36 v1(45.1,25.65) ; v1(299.85,63.75) v1(301.88,61.72) ; v1(124.97,116.2) 124.97,118.49 v1(124.33,119.13) 118.11,125.35 v1(116.33,125.35) ; v1(261.75,58.17) 261.75,59.56 v1(261.24,60.07) ; v1(217.81,78.23) 217.81,78.1 v1(216.15,76.45) ; v1(24.64,77.85) v1(27.05,77.85) ; v1(32.13,62.99) v1(33.66,64.52) ; v1(249.94,22.22) v1(249.94,24.76) ; v1(292.48,101.98) v1(295.02,101.98) ; v1(77.34,63.12) v1(75.31,63.12) ; v1(263.78,62.86) v1(262.06,62.86) ; v1(174.24,64.26) 174.88,64.26 v1(176.15,62.99) ; v1(8.64,121.54) 7.24,122.94 v1(6.6,122.94) ; v1(91.19,115.19) 90.04,115.19 v1(88.14,117.09) ; v1(28.45,27.43) 28.7,27.69 v1(28.7,29.46) ; v1(325.63,27.43) v1(327.91,29.72) ; v1(253.24,54.86) 254.38,53.72 255.02,53.72 v1(255.65,53.09) ; v1(178.82,73.02) v1(179.96,74.17) ; v1(236.73,80.14) 235.84,79.25 v1(234.82,79.25) ; v1(101.09,40.51) 101.73,41.15 v1(101.73,42.16) ; v1(272.42,56.13) 272.8,55.75 274.19,55.75 274.7,55.24 v1(274.7,54.1) ; v1(103.38,95.38) 107.19,95.38 v1(108.2,94.36) ; v1(68.33,26.16) v1(71.76,26.16) ; v1(299.21,45.59) v1(302.01,45.59) ; v1(225.43,99.57) v1(225.43,97.88) ; v1(186.18,53.72) v1(186.18,51.43) ; v1(131.7,58.04) v1(133.73,58.04) ; v1(30.99,120.9) v1(33.53,120.9) ; v1(282.07,124.59) 282.07,122.94 v1(282.32,122.68) ; v1(242.7,120.78) 243.08,120.4 v1(243.08,119.25) ; v1(46.36,103.25) 46.86,103.76 v1(46.86,105.92) ; v1(186.82,62.48) v1(182.63,62.48) ; v1(129.54,119.13) v1(126.37,119.13) ; v1(225.17,117.25) v1(225.17,118.74) ; v1(143.26,116.97) v1(143.26,114.93) ; v1(105.03,118.11) 105.92,119 v1(105.92,120.14) ; v1(86.61,118.49) v1(87.76,119.63) ; v1(215.77,40.39) v1(215.77,38.23) ; v1(287.91,25.78) 289.43,27.3 v1(289.43,29.59) ; v1(226.31,45.21) 227.58,43.94 v1(227.84,43.94) ; v1(286.39,100.96) v1(284.73,100.96) ; v1(50.67,64.52) v1(53.21,64.52) ; v1(13.08,25.78) v1(13.08,23.37) ; v1(242.7,56.26) 242.7,58.29 v1(242.19,58.8) ; v1(229.36,114.55) 229.11,114.81 v1(226.82,114.81) ; v1(263.53,99.57) v1(265.81,99.57) ; v1(94.74,130.56) v1(94.74,128.4) ; v1(33.78,104.52) 33.78,102.62 v1(33.66,102.49) ; v1(219.58,19.56) v1(220.85,20.83) ; v1(138.05,38.35) v1(139.19,39.5) ; v1(31.62,86.61) v1(33.15,88.14) ; v1(95.25,61.98) v1(97.03,61.98) ; v1(122.17,100.05) v1(122.17,98.06) ; v1(263.52,102.71) v1(263.52,101.13) ; v1(67.69,45.97) v1(67.69,43.69) ; v1(206.25,94.74) v1(207.82,94.74)